# EasyEDA Pro project 数据采集模块 V2.4.eprj (continued)
## Nets
3V3: C15.2 C16.2 C39.2 C56.2 C63.2 C70.2 C77.2 C84.2 C91.2 C98.2 H4.1 H4.2 R1.1 R2.1 R3.1 TP2.1 U5.4(VOUT) U21.8(DVDD) U24.8(DVDD) U26.8(DVDD) U28.8(DVDD) U30.8(DVDD) U32.8(DVDD) U34.8(DVDD) U36.8(DVDD)
5V: C1.2 C2.2 C3.2 C4.1 C9.2 C10.2 C27.1 C28.1 C42.1 D1.2 H3.8 R4.1 R36.1 R38.1 R50.1 R62.2 TP5.1 U1.58(VCC5) U1.59(VCC5) U1.60(VCC5) U2.3(VIN) U3.3(VIN) U3.8(EN–) U3.12(EN+) U5.3(VIN) U7.1 U7.2 U7.3 U7.4 U7.5 U7.6 U39.2(RE#) U39.3(SHDN#) U39.8(VCC) U40.2(RE#) U40.3(SHDN#) U40.8(VCC) U41.2(RE#) U41.3(SHDN#) U41.8(VCC)
+A3V3: C11.2 C12.1 C50.2 C57.2 C64.2 C71.2 C78.2 C85.2 C92.2 C99.2 R21.2 TP3.1 U3.11(OUT+) U6.1(VDD) U23.14(VDD) U25.14(VDD) U27.14(VDD) U29.14(VDD) U31.14(VDD) U33.14(VDD) U35.14(VDD) U37.14(VDD)
-A3V3: C6.2 C18.2 C51.2 C58.2 C65.2 C72.2 C79.2 C86.2 C93.2 C100.2 R27.2 TP4.1 U3.6(OUT–) U6.27(VSS) U23.3(VSS) U25.3(VSS) U27.3(VSS) U29.3(VSS) U31.3(VSS) U33.3(VSS) U35.3(VSS) U37.3(VSS)
A3V3: C7.2 C8.2 C13.2 C37.2 C55.2 C62.2 C69.2 C76.2 C83.2 C90.2 C97.2 TP1.1 U2.4(VOUT) U4.6(VS+) U21.5(AVDD) U24.5(AVDD) U26.5(AVDD) U28.5(AVDD) U30.5(AVDD) U32.5(AVDD) U34.5(AVDD) U36.5(AVDD)
AGND: C1.1 C3.1 C4.2 C5.1 C6.1 C7.1 C8.1 C11.1 C12.2 C13.1 C18.1 C37.1 C43.1 C48.2 C50.1 C51.1 C52.1 C54.2 C55.1 C57.1 C58.1 C59.1 C61.2 C62.1 C64.1 C65.1 C66.1 C68.2 C69.1 C71.1 C72.1 C73.1 C75.2 C76.1 C78.1 C79.1 C80.1 C82.2 C83.1 C85.1 C86.1 C87.1 C89.2 C90.1 C92.1 C93.1 C94.1 C96.2 C97.1 C99.1 C100.1 H1.1 H1.3 H1.5 H1.7 H1.9 H1.11 H1.13 H1.15 H1.17 H1.19 H1.21 H1.23 H1.25 H1.27 H1.29 H1.31 H2.1 R22.1 R24.2 R26.1 R28.1 TP6.1 TP7.1 TP8.1 U2.1(GND) U3.4(GND) U3.13(EP) U4.7(GND) U6.12(GND) U21.1(AGND) U23.15(GND) U24.1(AGND) U25.15(GND) U26.1(AGND) U27.15(GND) U28.1(AGND) U29.15(GND) U30.1(AGND) U31.15(GND) U32.1(AGND) U33.15(GND) U34.1(AGND) U35.15(GND) U36.1(AGND) U37.15(GND)
GND: C2.1 C9.1 C10.1 C15.1 C16.1 C27.2 C28.2 C39.1 C42.2 C56.1 C63.1 C70.1 C77.1 C84.1 C91.1 C98.1 CN1.2 CN2.2 CN3.2 CN4.2 D1.1 H3.6 H4.5 H4.6 H5.1 LED1.1(C) R26.2 R35.2 R37.2 R49.2 TP9.1 U1.1(GND) U1.30(GND) U1.91(GND) U4.1(A1) U4.2(A0) U5.1(GND) U7.7 U7.8 U7.9 U7.10 U7.11 U7.12 U21.14(DGND) U24.14(DGND) U26.14(DGND) U28.14(DGND) U30.14(DGND) U32.14(DGND) U34.14(DGND) U36.14(DGND) U39.5(GND) U40.5(GND) U41.5(GND)
ADG16_A0: U1.94(PI0) U6.17(A0)
ADG16_A1: U1.93(PI1) U6.16(A1)
ADG16_A2: U1.92(PI2) U6.15(A2)
ADG16_A3: U1.101(PI3) U6.14(A3)
ADG16_EN: U1.95(PG11) U6.18(EN)
ADG_A0: U1.96(PI4) U23.1(A0) U25.1(A0) U27.1(A0) U29.1(A0) U31.1(A0) U33.1(A0) U35.1(A0) U37.1(A0)
ADG_A1: U1.97(PI5) U23.16(A1) U25.16(A1) U27.16(A1) U29.16(A1) U31.16(A1) U33.16(A1) U35.16(A1) U37.16(A1)
ADG_EN: U1.98(PI6) U23.2(EN) U25.2(EN) U27.2(EN) U29.2(EN) U31.2(EN) U33.2(EN) U35.2(EN) U37.2(EN)
AP1: CN1.3 R33.2 R36.2 U39.6(A)
AP2: CN3.3 R42.2 R50.2 U41.6(A)
AP3: CN2.3 R34.2 R38.2 U40.6(A)
BN1: CN1.1 R33.1 R35.1 U39.7(B)
BN2: CN3.1 R42.1 R49.1 U41.7(B)
BN3: CN2.1 R34.1 R37.1 U40.7(B)
BOOT0: R25.1 U1.31(BOOT0)
BOOT1: R30.2 U1.55(PB2)
I2C1_SCL: R3.2 U1.24(PB6) U4.5(SCL)
I2C1_SDA: R2.2 U1.25(PB7) U4.4(SDA)
INA226_ALERT: R1.2 U4.3(Alert)
IP_1: H1.2 U6.19(S1)
IP_2: H1.4 U6.20(S2)
IP_3: H1.6 U6.21(S3)
IP_4: H1.8 U6.22(S4)
IP_5: H1.10 U6.23(S5)
IP_6: H1.12 U6.24(S6)
IP_7: H1.14 U6.25(S7)
IP_8: H1.16 U6.26(S8)
IP_9: H1.18 U6.11(S9)
IP_10: H1.20 U6.10(S10)
IP_11: H1.22 U6.9(S11)
IP_12: H1.24 U6.8(S12)
IP_13: H1.26 U6.7(S13)
IP_14: H1.28 U6.6(S14)
IP_15: H1.30 U6.5(S15)
IP_16: H1.32 U6.4(S16)
IP_X: R23.2 U6.28(D)
KN0_1: U23.13(S1B) U38.1
KN0_2: U23.12(S2B) U38.3
KN0_3: U23.11(S3B) U38.5
KN0_4: U23.10(S4B) U38.7
KN0_5: U25.13(S1B) U38.9
KN0_6: U25.12(S2B) U38.11
KN0_7: U25.11(S3B) U38.13
KN0_8: U25.10(S4B) U38.15
KN0_9: U31.13(S1B) U38.17
KN0_10: U31.12(S2B) U38.19
KN0_11: U31.11(S3B) U38.21
KN0_12: U31.10(S4B) U38.23
KN0_13: U33.13(S1B) U38.25
KN0_14: U33.12(S2B) U38.27
KN0_15: U33.11(S3B) U38.29
KN0_16: U33.10(S4B) U38.31
KN0_X: R43.1 R44.1 U23.9(DB)
KN1_1: U27.13(S1B) U38.33
KN1_2: U27.12(S2B) U38.35
KN1_3: U27.11(S3B) U38.37
KN1_4: U27.10(S4B) U38.39
KN1_5: U29.13(S1B) U38.41
KN1_6: U29.12(S2B) U38.43
KN1_7: U29.11(S3B) U38.45
KN1_8: U29.10(S4B) U38.47
KN1_9: U35.13(S1B) U38.49
KN1_10: U35.12(S2B) U38.51
KN1_11: U35.11(S3B) U38.53
KN1_12: U35.10(S4B) U38.55
KN1_13: U37.13(S1B) U38.57
KN1_14: U37.12(S2B) U38.59
KN1_15: U37.11(S3B) U38.61
KN1_16: U37.10(S4B) U38.63
KN1_X: R63.1 R64.1 U25.9(DB)
KN2_X: R72.1 R73.1 U31.9(DB)
KN3_X: R75.1 R76.1 U33.9(DB)
KN4_X: R66.1 R67.1 U27.9(DB)
KN5_X: R69.1 R70.1 U29.9(DB)
KN6_X: R78.1 R79.1 U35.9(DB)
KN7_X: R81.1 R82.1 U37.9(DB)
KP0_1: U23.4(S1A) U38.2
KP0_2: U23.5(S2A) U38.4
KP0_3: U23.6(S3A) U38.6
KP0_4: U23.7(S4A) U38.8
KP0_5: U25.4(S1A) U38.10
KP0_6: U25.5(S2A) U38.12
KP0_7: U25.6(S3A) U38.14
KP0_8: U25.7(S4A) U38.16
KP0_9: U31.4(S1A) U38.18
KP0_10: U31.5(S2A) U38.20
KP0_11: U31.6(S3A) U38.22
KP0_12: U31.7(S4A) U38.24
KP0_13: U33.4(S1A) U38.26
KP0_14: U33.5(S2A) U38.28
KP0_15: U33.6(S3A) U38.30
KP0_16: U33.7(S4A) U38.32
KP0_X: R45.1 U23.8(DA)
KP1_1: U27.4(S1A) U38.34
KP1_2: U27.5(S2A) U38.36
KP1_3: U27.6(S3A) U38.38
KP1_4: U27.7(S4A) U38.40
KP1_5: U29.4(S1A) U38.42
KP1_6: U29.5(S2A) U38.44
KP1_7: U29.6(S3A) U38.46
KP1_8: U29.7(S4A) U38.48
KP1_9: U35.4(S1A) U38.50
KP1_10: U35.5(S2A) U38.52
KP1_11: U35.6(S3A) U38.54
KP1_12: U35.7(S4A) U38.56
KP1_13: U37.4(S1A) U38.58
KP1_14: U37.5(S2A) U38.60
KP1_15: U37.6(S3A) U38.62
KP1_16: U37.7(S4A) U38.64
KP1_X: R65.1 U25.8(DA)
KP2_X: R74.1 U31.8(DA)
KP3_X: R77.1 U33.8(DA)
KP4_X: R68.1 U27.8(DA)
KP5_X: R71.1 U29.8(DA)
KP6_X: R80.1 U35.8(DA)
KP7_X: R83.1 U37.8(DA)
LM_FB+: R21.1 R22.2 U3.2(FB+)
LM_FB-: R27.1 R28.2 U3.7(FB–)
MAX31856_CS_0: U1.23(PB5) U21.9(CS#)
MAX31856_CS_1: U1.19(PE3) U24.9(CS#)
MAX31856_CS_2: U1.16(PE6) U30.9(CS#)
MAX31856_CS_3: U1.6(PH3) U32.9(CS#)
MAX31856_CS_4: U1.11(PF9) U26.9(CS#)
MAX31856_CS_5: U1.70(PH9) U28.9(CS#)
MAX31856_CS_6: U1.67(PB15) U34.9(CS#)
MAX31856_CS_7: U1.64(PB12) U36.9(CS#)
MAX31856_DRDY_0: U1.21(PB3) U21.7(DRDY#)
MAX31856_DRDY_1: U1.20(PE2) U24.7(DRDY#)
MAX31856_DRDY_2: U1.17(PE5) U30.7(DRDY#)
MAX31856_DRDY_3: U1.13(PF7) U32.7(DRDY#)
MAX31856_DRDY_4: U1.12(PF8) U26.7(DRDY#)
MAX31856_DRDY_5: U1.71(PH10) U28.7(DRDY#)
MAX31856_DRDY_6: U1.68(PH6) U34.7(DRDY#)
MAX31856_DRDY_7: U1.65(PB13) U36.7(DRDY#)
MAX31856_FAULT_0: U1.22(PB4) U21.13(FAULT#)
MAX31856_FAULT_1: U1.18(PE4) U24.13(FAULT#)
MAX31856_FAULT_2: U1.15(PI11) U30.13(FAULT#)
MAX31856_FAULT_3: U1.5(PH2) U32.13(FAULT#)
MAX31856_FAULT_4: U1.9(PC1) U26.13(FAULT#)
MAX31856_FAULT_5: U1.69(PH7) U28.13(FAULT#)
MAX31856_FAULT_6: U1.66(PB14) U34.13(FAULT#)
MAX31856_FAULT_7: U1.63(PH8) U36.13(FAULT#)
MAX31856_SCK: U1.46(PA5) U21.10(SCK) U24.10(SCK) U26.10(SCK) U28.10(SCK) U30.10(SCK) U32.10(SCK) U34.10(SCK) U36.10(SCK)
MAX31856_SDI: U1.48(PA7) U21.12(SDI) U24.12(SDI) U26.12(SDI) U28.12(SDI) U30.12(SDI) U32.12(SDI) U34.12(SDI) U36.12(SDI)
MAX31856_SDO: U1.47(PA6) U21.11(SDO) U24.11(SDO) U26.11(SDO) U28.11(SDO) U30.11(SDO) U32.11(SDO) U34.11(SDO) U36.11(SDO)
REST: R29.2 U1.10(REST)
RS485_1_RX: U1.62(PB10) U39.4(DI)
RS485_1_TX: U1.61(PB11) U39.1(RO)
RS485_2_RX: U1.38(PC12) U41.4(DI)
RS485_2_TX: U1.37(PD2) U41.1(RO)
RS485_3_RX: U1.76(PC6) U40.4(DI)
RS485_3_TX: U1.77(PC7) U40.1(RO)
SWCLK: H3.2 U1.42(PA14)
SWDIO: H3.4 U1.43(PA13)
T0+: C43.2 C46.1 R45.2 U21.4(T+)
T0-: C46.2 C48.1 R44.2 U21.3(T-)
T1+: C52.2 C53.1 R65.2 U24.4(T+)
T1-: C53.2 C54.1 R63.2 U24.3(T-)
T2+: C73.2 C74.1 R74.2 U30.4(T+)
T2-: C74.2 C75.1 R72.2 U30.3(T-)
T3+: C80.2 C81.1 R77.2 U32.4(T+)
T3-: C81.2 C82.1 R75.2 U32.3(T-)
T4+: C59.2 C60.1 R68.2 U26.4(T+)
T4-: C60.2 C61.1 R66.2 U26.3(T-)
T5+: C66.2 C67.1 R71.2 U28.4(T+)
T5-: C67.2 C68.1 R69.2 U28.3(T-)
T6+: C87.2 C88.1 R80.2 U34.4(T+)
T6-: C88.2 C89.1 R78.2 U34.3(T-)
T7+: C94.2 C95.1 R83.2 U36.4(T+)
T7-: C95.2 C96.1 R81.2 U36.3(T-)
TTL_0_RX: CN4.1 U1.104(PE1)
TTL_0_TX: CN4.3 U1.103(PE0)
USART1_RX: H3.1 U1.52(PA10)
USART1_TX: H3.3 U1.51(PA9)
$1N15083: C17.2 R23.1 U4.10(VIN+)
$1N15089: C17.1 R24.1 U4.9(VIN-)
$1N29134: R43.2 U21.2(BIAS)
$1N35942: C14.2 U3.10(C1+)
$1N35947: C14.1 U3.9(C1–)
$1N36002: R4.2 U3.1(PGOOD)
$1N36045: C5.2 U3.5(CP)
$1N46830: H4.3 R25.2
$1N46836: H4.4 R30.1
$1N81567: H3.5 R29.1
$1N87410: LED1.2(A) R62.1
$1N116519: R64.2 U24.2(BIAS)
$1N118259: R67.2 U26.2(BIAS)
$1N118329: R70.2 U28.2(BIAS)
$1N121739: R73.2 U30.2(BIAS)
$1N121809: R76.2 U32.2(BIAS)
$1N121879: R79.2 U34.2(BIAS)
$1N121949: R82.2 U36.2(BIAS)

Not connected (* = marked no-connect by the designer): H3 7*; U1 2(VREF+) 3(PA1) 4(PA2) 7(PH5) 8(PH4) 14(PF6) 26(PB8) 27(PB9) 28(PC13) 29(VBAT) 32(PG14) 33(PG13) 34(PG10) 35(PD7) 36(PD3) 39(PC11) 40(PC10) 41(PA15) 44(PA3) 45(PA4) 49(PC4) 50(PC5) 53(PA11) 54(PA12) 56(PB0) 57(PB1) 72(PH11) 73(PG3) 74(PD13) 75(PG6) 78(PC8) 79(PC9) 80(PA8) 81(PD12) 82(PD5) 83(PD11) 84(PH12) 85(PG12) 86(PD4) 87(PD6) 88(PH15) 89(PH14) 90(PH13) 99(PI7) 100(PI8) 102(PA0) 105(PD14) 106(PD15) 107(PD0) 108(PD1) 109(PE7) 110(PE8) 111(PE9) 112(PE10) 113(PE11) 114(PE12) 115(PE13) 116(PE14) 117(PE15) 118(PD8) 119(PD9) 120(PD10); U2 2(VOUT)*; U4 8(VBUS)*; U5 2(VOUT)*; U6 2(NC)* 3(NC)* 13(NC)*; U21 6(DNC)*; U24 6(DNC)*; U26 6(DNC)*; U28 6(DNC)*; U30 6(DNC)*; U32 6(DNC)*; U34 6(DNC)*; U36 6(DNC)*

## Notes on the sheets
sheet 1
- STM32
- INA226
- ps.连接树莓派串口
- 485
- POWER
sheet 2
- MAX31856

# Schematic Schematic2
Board Name: Board2; Create Date: 2024-10-21; Page Name: 底板; Project Name: 数据采集模块 V2.4; Schematic Name: Schematic2; Update Date: 2025-04-19; Company: 嘉立创EDA; Page Size: A4; Version: V1.0
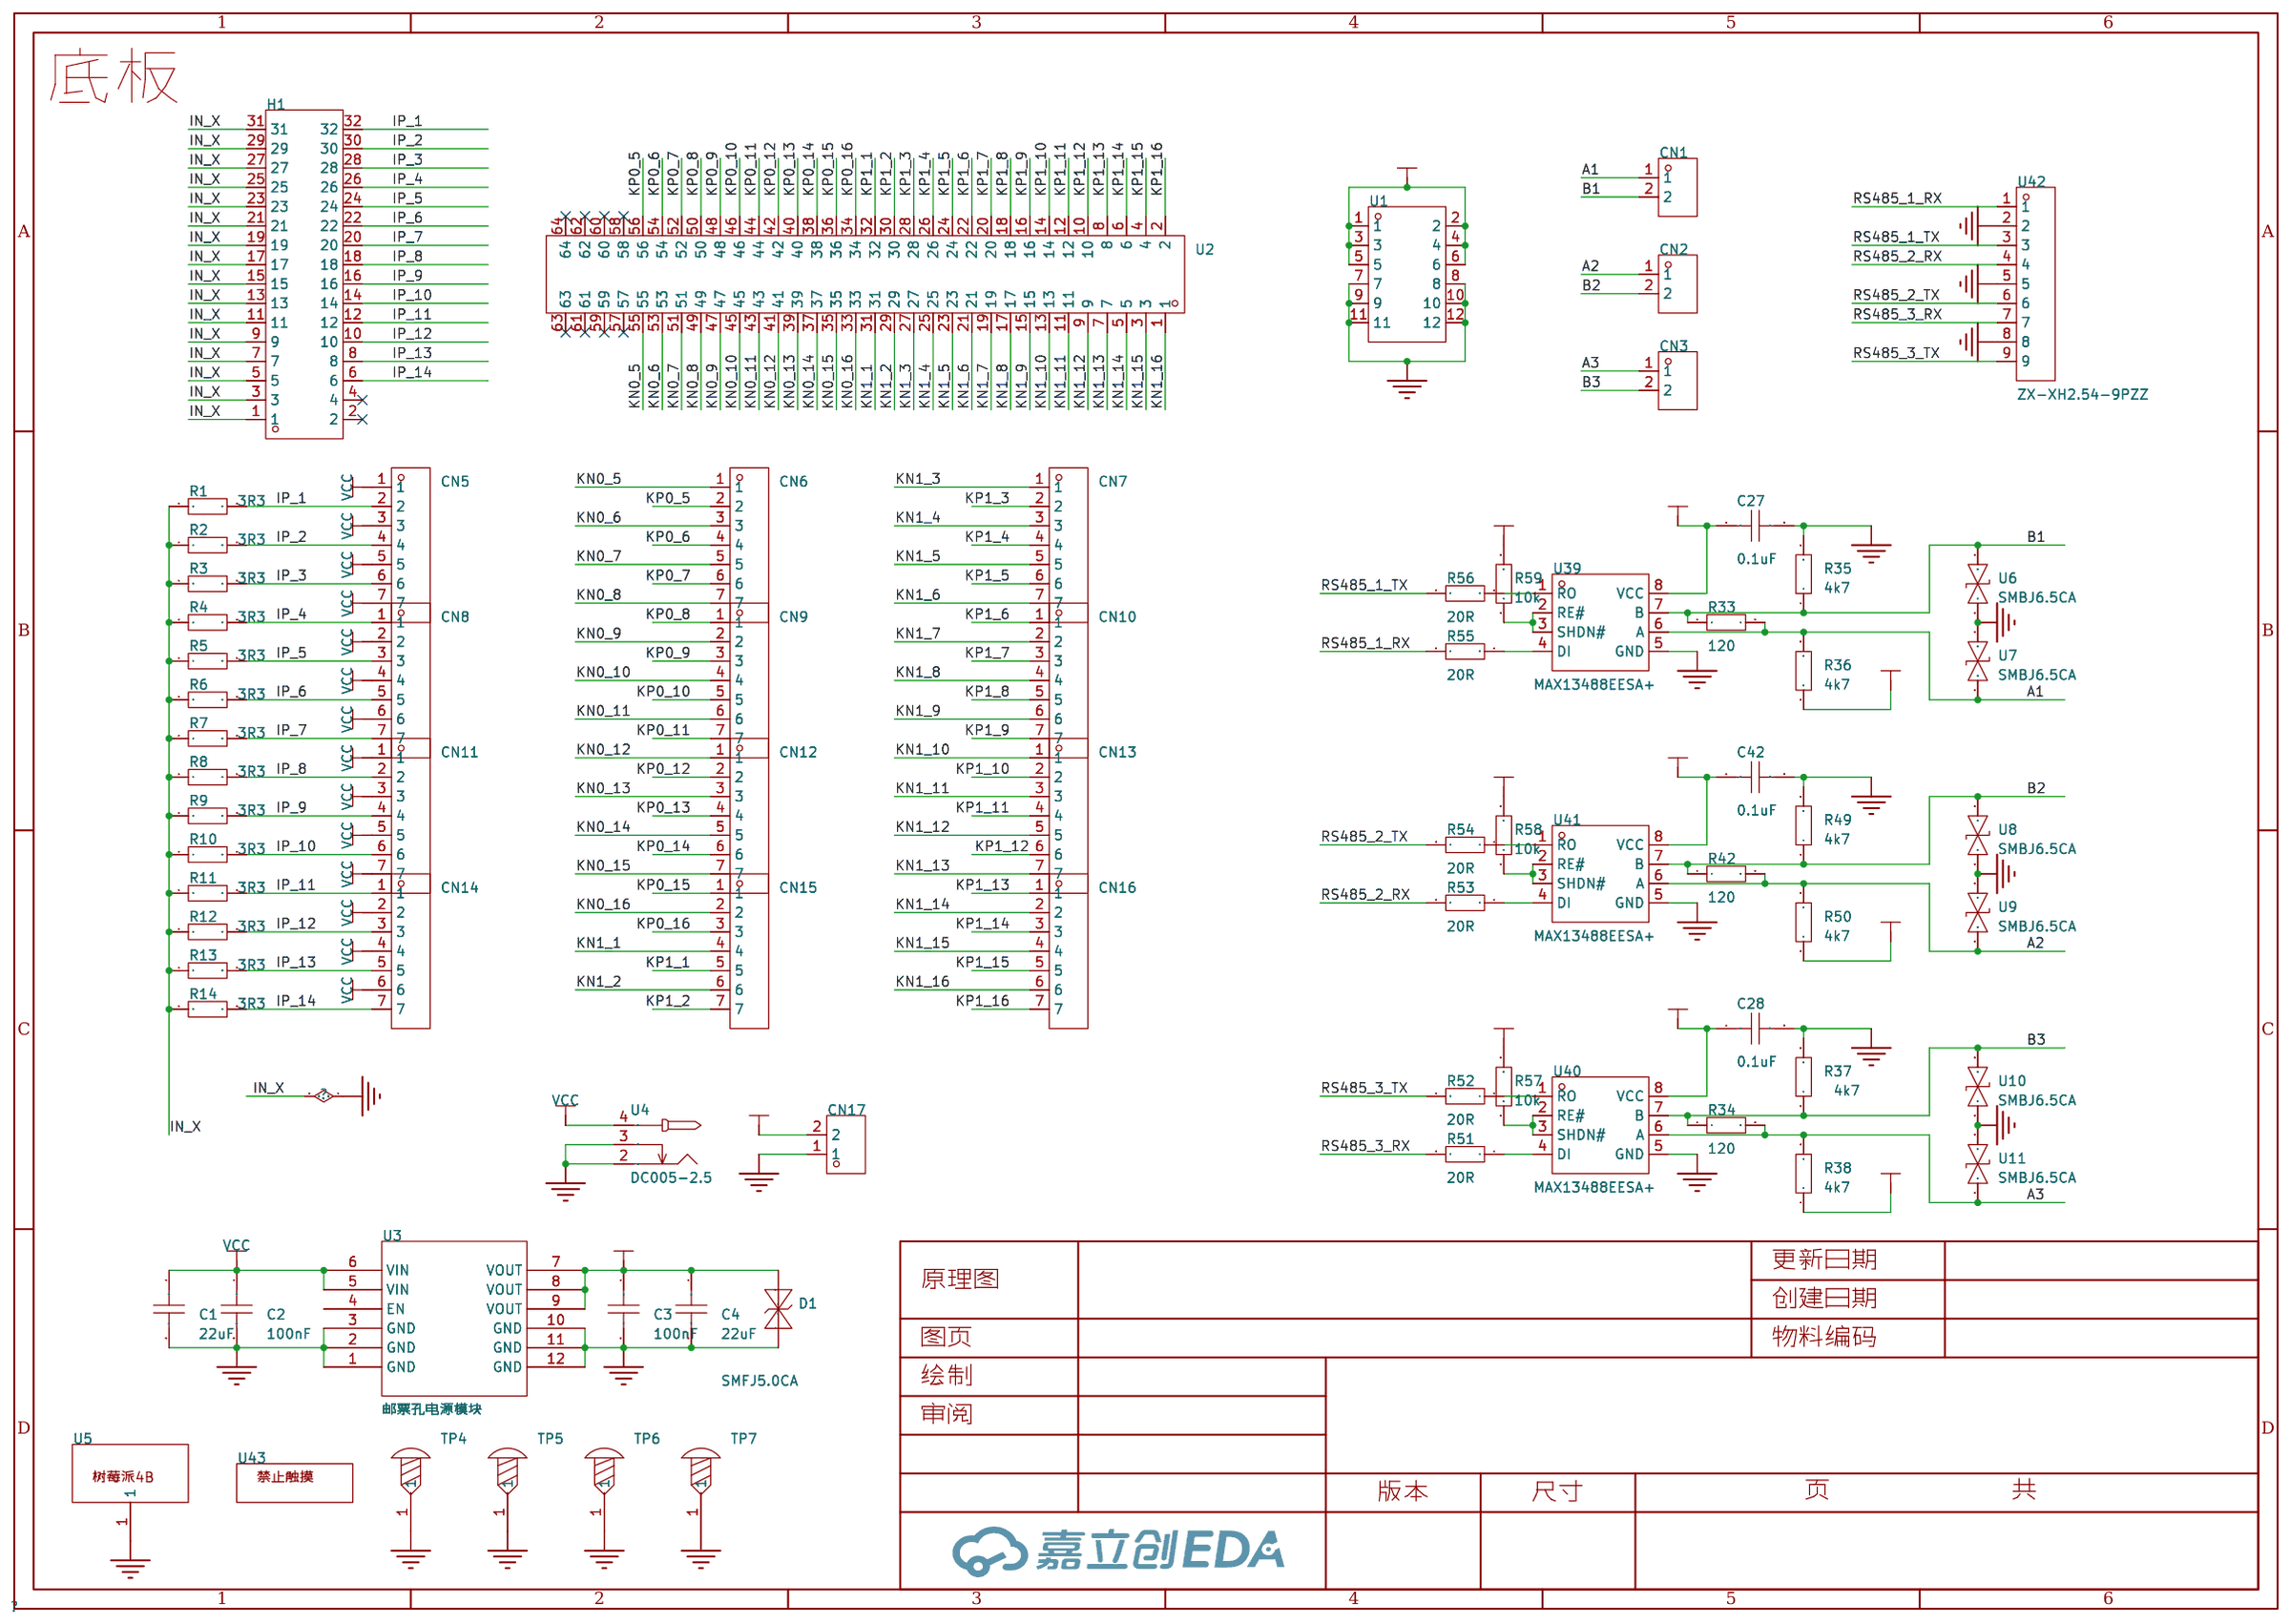
[diagram p2: schematic sheet]

## Parts
C1  22uF  [C0805]
C2  100nF  [C0603]
C3  100nF  [C0603]
C4  22uF  [C0805]
C27  0.1uF  [C0603]
C28  0.1uF  [C0603]
C42  0.1uF  [C0603]
CN1  KF2EDGR-5.08-2P  [CONN-TH_2P-P5.08_KF2EDGR-5.08-2P]
CN2  KF2EDGR-5.08-2P  [CONN-TH_2P-P5.08_KF2EDGR-5.08-2P]
CN3  KF2EDGR-5.08-2P  [CONN-TH_2P-P5.08_KF2EDGR-5.08-2P]
CN5  KF2EDGR-5.08-7P  [CONN-TH_7P-P5.08_KF2EDGR-5.08-7P]
CN6  KF2EDGR-5.08-7P  [CONN-TH_7P-P5.08_KF2EDGR-5.08-7P]
CN7  KF2EDGR-5.08-7P  [CONN-TH_7P-P5.08_KF2EDGR-5.08-7P]
CN8  KF2EDGR-5.08-7P  [CONN-TH_7P-P5.08_KF2EDGR-5.08-7P]
CN9  KF2EDGR-5.08-7P  [CONN-TH_7P-P5.08_KF2EDGR-5.08-7P]
CN10  KF2EDGR-5.08-7P  [CONN-TH_7P-P5.08_KF2EDGR-5.08-7P]
CN11  KF2EDGR-5.08-7P  [CONN-TH_7P-P5.08_KF2EDGR-5.08-7P]
CN12  KF2EDGR-5.08-7P  [CONN-TH_7P-P5.08_KF2EDGR-5.08-7P]
CN13  KF2EDGR-5.08-7P  [CONN-TH_7P-P5.08_KF2EDGR-5.08-7P]
CN14  KF2EDGR-5.08-7P  [CONN-TH_7P-P5.08_KF2EDGR-5.08-7P]
CN15  KF2EDGR-5.08-7P  [CONN-TH_7P-P5.08_KF2EDGR-5.08-7P]
CN16  KF2EDGR-5.08-7P  [CONN-TH_7P-P5.08_KF2EDGR-5.08-7P]
CN17  ZX-XH2.54-2PZZ  [CONN-TH_2P-P2.50_HX25003-2A]
D1  SMFJ5.0CA  [SOD-123_L2.7-W1.8-LS3.7-BI]
H1  X6521WV-2x16H-C60D30  [HDR-TH_32P-2.54-V-M-R2-C16-S2.54]
R1  3R3  [R1206]
R2  3R3  [R1206]
R3  3R3  [R1206]
R4  3R3  [R1206]
R5  3R3  [R1206]
R6  3R3  [R1206]
R7  3R3  [R1206]
R8  3R3  [R1206]
R9  3R3  [R1206]
R10  3R3  [R1206]
R11  3R3  [R1206]
R12  3R3  [R1206]
R13  3R3  [R1206]
R14  3R3  [R1206]
R33  120  [R0603]
R34  120  [R0603]
R35  4k7  [R0603]
R36  4k7  [R0603]
R37  4k7  [R0603]
R38  4k7  [R0603]
R42  120  [R0603]
R49  4k7  [R0603]
R50  4k7  [R0603]
R51  20R  [R0603]
R52  20R  [R0603]
R53  20R  [R0603]
R54  20R  [R0603]
R55  20R  [R0603]
R56  20R  [R0603]
R57  10k  [R0603]
R58  10k  [R0603]
R59  10k  [R0603]
TP4  -  [M3螺丝]
TP5  -  [M3螺丝]
TP6  -  [M3螺丝]
TP7  -  [M3螺丝]
U1  PZ254-2-06-Z-8.5KK  [HDR-TH_12P-P2.54-V-M-R2-C6-S2.54]
U2  X6521WV-2x32H-C60D30  [HDR-TH_64P-P2.54-V-M-R2-C32-S2.54-3]
U3  邮票孔电源模块  [邮票孔电源模块]
U4  DC005-2.5  [DC-IN-TH_DC005-2.5MM]
U5  -  [树莓派4B]
U6  SMBJ6.5CA  [SMB_L4.6-W3.5-LS5.3-BI]
U7  SMBJ6.5CA  [SMB_L4.6-W3.5-LS5.3-BI]
U8  SMBJ6.5CA  [SMB_L4.6-W3.5-LS5.3-BI]
U9  SMBJ6.5CA  [SMB_L4.6-W3.5-LS5.3-BI]
U10  SMBJ6.5CA  [SMB_L4.6-W3.5-LS5.3-BI]
U11  SMBJ6.5CA  [SMB_L4.6-W3.5-LS5.3-BI]
U39  MAX13488EESA+  [SO-8_L4.9-W3.9-P1.27-LS6.0-TL]
U40  MAX13488EESA+  [SO-8_L4.9-W3.9-P1.27-LS6.0-TL]
U41  MAX13488EESA+  [SO-8_L4.9-W3.9-P1.27-LS6.0-TL]
U42  ZX-XH2.54-9PZZ  [CONN-TH_9P-P2.50_ZX-XH2.54-9PZZ]
U43  -  [禁止触摸LOGO]

## Library data of the parts
C1 C4 = CAP_0805: Supplier Footprint: 0805
C2 C3 C27 C28 C42 = CAP_0603: Supplier Footprint: 0603
CN1-CN3 = KF2EDGR-5.08-2P: 连接器类型:板端/插座-开口;结构:1x2P;间距:5.08mm;颜色:绿色;安装方式:弯针;排数:1;每排PIN数:2;额定电流:15A;额定电压:300V;工作温度范围:-40℃~+105℃;; LCSC Part Name: 5.08mm 1x2P 排数:1 每排P数:2; Supplier Part: C441204; Manufacturer: KEFA(科发); Supplier Footprint: 弯插,P=5.08mm; JLCPCB Part Class: 扩展库; Datasheet: https://atta.szlcsc.com/upload/public/pdf/source/20230331/86255A6DF04E9E39F33DE3CFE8B3614A.pdf; Supplier: LCSC; Connector Type: 板端/插座-开口; Structure: 1x2P; Pitch: 5.08mm; Color: 绿色; Mounting Style: 弯针; Number of Pins: 2P; Number of Rows: 1; Number of PINs Per Row: 2; Current Rating (Max): 15A; Voltage Rating (Max): 300V; Operating Temperature Range: -40℃~+105℃
CN5-CN16 = KF2EDGR-5.08-7P: 连接器类型:板端/插座-开口;结构:1x7P;间距:5.08mm;颜色:绿色;安装方式:弯针;排数:1;每排PIN数:7;额定电流:15A;额定电压:300V;工作温度范围:-40℃~+105℃;; LCSC Part Name: 5.08mm 1x7P 排数:1 每排P数:7; Supplier Part: C441209; Manufacturer: KEFA(科发); Supplier Footprint: 弯插,P=5.08mm; JLCPCB Part Class: 扩展库; Datasheet: https://atta.szlcsc.com/upload/public/pdf/source/20230331/86255A6DF04E9E39F33DE3CFE8B3614A.pdf; Supplier: LCSC; Connector Type: 板端/插座-开口; Structure: 1x7P; Pitch: 5.08mm; Color: 绿色; Mounting Style: 弯针; Number of Pins: 7P; Number of Rows: 1; Number of PINs Per Row: 7; Current Rating (Max): 15A; Voltage Rating (Max): 300V; Operating Temperature Range: -40℃~+105℃
CN17 = ZX-XH2.54-2PZZ: 插针结构:1x2P;间距:2.54mm;安装方式:直插;参考系列:XH;总PIN数:2P;排数:1;每排PIN数:2;行距:-;额定电流:3A;触头材质:黄铜;触头镀层:锡;工作温度范围:-25℃~+85℃;; Supplier Part: C7429632; Manufacturer: Megastar(兆星); Supplier Footprint: 插件,P=2.54mm; JLCPCB Part Class: 扩展库; Datasheet: https://atta.szlcsc.com/upload/public/pdf/source/20230619/19BA6947230AA44A04D3EDD65E618FD0.pdf; Supplier: LCSC; Pins Structure: 1x2P; Pitch: 2.54mm; Mounting Style: 直插; Reference Series: XH; Number of Pins: 2P; Number of Rows: 1; Number of PINs Per Row: 2; Current Rating (Max): 3A; Contact Material: 黄铜; Contact Plating: 锡; Operating Temperature Range: -25℃~+85℃
D1 = SMFJ5.0CA: 反向截止电压(Vrwm):5V;最大钳位电压:9.2V;峰值脉冲电流(Ipp)@10/1000us:21.7A;击穿电压:6.4V;; Supplier Part: C2905638; Manufacturer: TECH PUBLIC(台舟); Supplier Footprint: SOD-123FL; JLCPCB Part Class: 扩展库; Datasheet: https://atta.szlcsc.com/upload/public/pdf/source/20211026/3B8FA2C5551EFBFD99ABC853C5618374.pdf; Supplier: LCSC; Reverse Stand-Off Voltage (Vrwm): 5V; Maximum Clamping Voltage: 9.2V; Peak Pulse Current (Ipp)@10/1000us: 21.7A; Breakdown Voltage: 6.4V; Reverse Leakage Current (Ir): 400uA; Type: TVS
H1 = X6521WV-2x16H-C60D30: 插针结构:2x16P;间距:2.54mm;行距:2.54mm;圆针/方针:方针;安装类型:-;排数:双排;总PIN位数:32P;额定电流:3A;额定电压:250V;配合针长度:-;塑高:2.5mm;端接针长度:-;触头材质:黄铜;触头镀层:金;工作温度范围:-40℃~+105℃;焊接温度(最大值):260℃;颜色:黑色;; LCSC Part Name: 2x16P 间距:2.54mm 方针; Supplier Part: C725888; Manufacturer: XKB Connection(中国星坤); Supplier Footprint: 插件,P=2.54mm; JLCPCB Part Class: 扩展库; Datasheet: https://atta.szlcsc.com/upload/public/pdf/source/20211009/DE33EBA4104B5B447A7BD8383FBBA145.pdf; Supplier: LCSC; Pin Structure: 2x16P; Pitch: 2.54mm; Row Spacing: 2.54mm; Circluar Pins/Square Pins: 方针; Number of Rows: 双排; Number of Pins: 32P; Current Rating (Max): 3A; Voltage Rating (Max): 250V; Insulation Height: 2.5mm; Contact Material: 黄铜; Contact Plating: 金; Operating Temperature Range: -40℃~+105℃; Soldering Temperature(Max): 260℃; Color: 黑色
R1-R14 = Res_1206: Supplier Footprint: 1206
R33-R38 R42 R49-R59 = Res_0603: Supplier Footprint: 0603
TP4-TP7 = M3螺丝: Supplier Footprint: 插件
U1 = PZ254-2-06-Z-8.5KK: LCSC Part Name: 2.54mm 被合并商品; Supplier Part: C3012246; Supplier Footprint: 插件,P=2.54mm; JLCPCB Part Class: 扩展库; Supplier: LCSC
U2 = X6521WV-2x32H-C60D30: 插针结构:2x32P;间距:2.54mm;行距:2.54mm;圆针/方针:方针;安装类型:-;排数:双排;总PIN位数:64P;额定电流:3A;额定电压:250V;配合针长度:-;塑高:2.5mm;端接针长度:-;触头材质:黄铜;触头镀层:金;工作温度范围:-40℃~+105℃;焊接温度(最大值):260℃;颜色:黑色;; LCSC Part Name: 2x32P 间距:2.54mm 方针; Supplier Part: C2883966; Manufacturer: XKB Connection(中国星坤); Supplier Footprint: 插件,P=2.54mm; JLCPCB Part Class: 扩展库; Datasheet: https://atta.szlcsc.com/upload/public/pdf/source/20230515/3562B41AC32B1731F21EFD73DC35CC6C.pdf; Supplier: LCSC; Pin Structure: 2x32P; Pitch: 2.54mm; Row Spacing: 2.54mm; Circluar Pins/Square Pins: 方针; Number of Rows: 双排; Number of Pins: 64P; Current Rating (Max): 3A; Voltage Rating (Max): 250V; Insulation Height: 2.5mm; Contact Material: 黄铜; Contact Plating: 金; Operating Temperature Range: -40℃~+105℃; Soldering Temperature(Max): 260℃; Color: 黑色
U3 = 邮票孔电源模块: kvdz.taobao.com; Library Name: 邮票孔电源模块ylt
U4 = DC005-2.5: 连接器类型:DC电源插座;安装方式:弯插;触点内径:2.5mm;触点外径:6.3mm;额定电流:500mA;额定电压:12V;工作温度范围:-25℃~+85℃;; LCSC Part Name: DC电源插座 内径:2.5mm 外径:6.3mm; Supplier Part: C7507454; Manufacturer: SHOU HAN(首韩); Supplier Footprint: 插件; JLCPCB Part Class: 扩展库; Datasheet: https://atta.szlcsc.com/upload/public/pdf/source/20231013/7634FFE9E6B635EE77C0C008CDC877DB.pdf; Supplier: LCSC; Connector Type: DC电源插座; Mounting Style: 弯插; Inside Contact Diameter: 2.5mm; Outside Contact Diameter: 6.3mm; Current Rating (Max): 500mA; Voltage Rating (Max): 12V; Operating Temperature Range: -25℃~+85℃
U5 = 树莓派4B
U6-U11 = SMBJ6.5CA_C7420377: 极性:双向;反向截止电压(Vrwm):6.5V;最大钳位电压:11.2V;峰值脉冲电流(Ipp)@10/1000us:53.57A;峰值脉冲功率(Ppp)@10/1000us:600W;击穿电压:7.22V;; Supplier Part: C7420377; Manufacturer: 宏迦橙; Supplier Footprint: SMB; JLCPCB Part Class: 扩展库; Datasheet: https://atta.szlcsc.com/upload/public/pdf/source/20240521/1CEEED45C5E1E6D6901B31DABD34A136.pdf; Supplier: LCSC; polarity: 双向; Reverse Stand-Off Voltage (Vrwm): 6.5V; Maximum Clamping Voltage: 11.2V; Peak Pulse Current (Ipp)@10/1000us: 53.57A; Peak Pulse Power Dissipation (Ppp)@10/1000us: 600W; Breakdown Voltage: 7.22V; Reverse Leakage Current (Ir): 500uA; Number of Lines: 单路; Operating Temperature: -55℃~+155℃; Type: TVS
U39-U41 = MAX13488EESA+: 类型:收发器;数据速率:16Mbps;驱动器/接收器:1/1;; LCSC Part Name: MAX13488EESA; Supplier Part: C143343; Manufacturer: ADI(亚德诺)/MAXIM(美信); Supplier Footprint: SO-8; JLCPCB Part Class: 扩展库; Datasheet: https://atta.szlcsc.com/upload/public/pdf/source/20171202/C156258_15122106256341160224.pdf; Supplier: LCSC; Types: 收发器; Supply Voltage: 4.75V~5.25V; Data Rate: 16Mbps; Driver/receiver: 1/1; Operating Temperature: -40℃~+85℃
U42 = ZX-XH2.54-9PZZ: Supplier Part: C7429639; Manufacturer: Megastar(兆星); Supplier Footprint: 插件,P=2.54mm; JLCPCB Part Class: 扩展库; Datasheet: https://atta.szlcsc.com/upload/public/pdf/source/20230619/A41EC9057C60B306F9C507100E2CF652.pdf; Supplier: LCSC; Pins Structure: 1x9P; Pitch: 2.54mm; Mounting Style: 直插; Reference Series: XH; Number of Pins: 9P; Number of Rows: 1; Number of PINs Per Row: 9; Current Rating (Max): 3A; Contact Material: 黄铜; Contact Plating: 锡; Operating Temperature Range: -25℃~+85℃
U43 = 禁止触摸LOGO

## Nets
5V: C3.1 C4.1 C27.1 C28.1 C42.1 CN17.2 D1.2 R36.1 R38.1 R50.1 R57.2 R58.2 R59.2 U1.1 U1.2 U1.3 U1.4 U1.5 U1.6 U3.7(VOUT) U3.8(VOUT) U3.9(VOUT) U39.8(VCC) U40.8(VCC) U41.8(VCC)
GND: C1.2 C2.2 C3.2 C4.2 C27.2 C28.2 C42.2 CN17.1 D1.1 H1.1 H1.3 H1.5 H1.7 H1.9 H1.11 H1.13 H1.15 H1.17 H1.19 H1.21 H1.23 H1.25 H1.27 H1.29 H1.31 R1.1 R2.1 R3.1 R4.1 R5.1 R6.1 R7.1 R8.1 R9.1 R10.1 R11.1 R12.1 R13.1 R14.1 R35.2 R37.2 R49.2 TP4.1 TP5.1 TP6.1 TP7.1 U1.7 U1.8 U1.9 U1.10 U1.11 U1.12 U3.1(GND) U3.2(GND) U3.3(GND) U3.10(GND) U3.11(GND) U3.12(GND) U4.2 U4.3 U5.1 U6.1 U7.2 U8.1 U9.2 U10.1 U11.2 U39.5(GND) U40.5(GND) U41.5(GND) U42.2 U42.5 U42.8
VCC: C1.1 C2.1 CN5.1 CN5.3 CN5.5 CN5.7 CN8.2 CN8.4 CN8.6 CN11.1 CN11.3 CN11.5 CN11.7 CN14.2 CN14.4 CN14.6 U3.5(VIN) U3.6(VIN) U4.4
A1: CN1.1 R33.2 R36.2 U7.1 U39.6(A)
A2: CN2.1 R42.2 R50.2 U9.1 U41.6(A)
A3: CN3.1 R34.2 R38.2 U11.1 U40.6(A)
B1: CN1.2 R33.1 R35.1 U6.2 U39.7(B)
B2: CN2.2 R42.1 R49.1 U8.2 U41.7(B)
B3: CN3.2 R34.1 R37.1 U10.2 U40.7(B)
IP_1: CN5.2 H1.32 R1.2
IP_2: CN5.4 H1.30 R2.2
IP_3: CN5.6 H1.28 R3.2
IP_4: CN8.1 H1.26 R4.2
IP_5: CN8.3 H1.24 R5.2
IP_6: CN8.5 H1.22 R6.2
IP_7: CN8.7 H1.20 R7.2
IP_8: CN11.2 H1.18 R8.2
IP_9: CN11.4 H1.16 R9.2
IP_10: CN11.6 H1.14 R10.2
IP_11: CN14.1 H1.12 R11.2
IP_12: CN14.3 H1.10 R12.2
IP_13: CN14.5 H1.8 R13.2
IP_14: CN14.7 H1.6 R14.2
KN0_5: CN6.1 U2.55
KN0_6: CN6.3 U2.53
KN0_7: CN6.5 U2.51
KN0_8: CN6.7 U2.49
KN0_9: CN9.2 U2.47
KN0_10: CN9.4 U2.45
KN0_11: CN9.6 U2.43
KN0_12: CN12.1 U2.41
KN0_13: CN12.3 U2.39
KN0_14: CN12.5 U2.37
KN0_15: CN12.7 U2.35
KN0_16: CN15.2 U2.33
KN1_1: CN15.4 U2.31
KN1_2: CN15.6 U2.29
KN1_3: CN7.1 U2.27
KN1_4: CN7.3 U2.25
KN1_5: CN7.5 U2.23
KN1_6: CN7.7 U2.21
KN1_7: CN10.2 U2.19
KN1_8: CN10.4 U2.17
KN1_9: CN10.6 U2.15
KN1_10: CN13.1 U2.13
KN1_11: CN13.3 U2.11
KN1_12: CN13.5 U2.9
KN1_13: CN13.7 U2.7
KN1_14: CN16.2 U2.5
KN1_15: CN16.4 U2.3
KN1_16: CN16.6 U2.1
KP0_5: CN6.2 U2.56
KP0_6: CN6.4 U2.54
KP0_7: CN6.6 U2.52
KP0_8: CN9.1 U2.50
KP0_9: CN9.3 U2.48
KP0_10: CN9.5 U2.46
KP0_11: CN9.7 U2.44
KP0_12: CN12.2 U2.42
KP0_13: CN12.4 U2.40
KP0_14: CN12.6 U2.38
KP0_15: CN15.1 U2.36
KP0_16: CN15.3 U2.34
KP1_1: CN15.5 U2.32
KP1_2: CN15.7 U2.30
KP1_3: CN7.2 U2.28
KP1_4: CN7.4 U2.26
KP1_5: CN7.6 U2.24
KP1_6: CN10.1 U2.22
KP1_7: CN10.3 U2.20
KP1_8: CN10.5 U2.18
KP1_9: CN10.7 U2.16
KP1_10: CN13.2 U2.14
KP1_11: CN13.4 U2.12
KP1_12: CN13.6 U2.10
KP1_13: CN16.1 U2.8
KP1_14: CN16.3 U2.6
KP1_15: CN16.5 U2.4
KP1_16: CN16.7 U2.2
RS485_1_RX: R55.2 U42.1
RS485_1_TX: R56.2 U42.3
RS485_2_RX: R53.2 U42.4
RS485_2_TX: R54.2 U42.6
RS485_3_RX: R51.2 U42.7
RS485_3_TX: R52.2 U42.9
$1N43756: R58.1 U41.2(RE#) U41.3(SHDN#)
$1N43769: R57.1 U40.2(RE#) U40.3(SHDN#)
$1N43779: R59.1 U39.2(RE#) U39.3(SHDN#)
$1N44097: R51.1 U40.4(DI)
$1N44147: R52.1 U40.1(RO)
$1N44197: R53.1 U41.4(DI)
$1N44199: R54.1 U41.1(RO)
$1N44249: R55.1 U39.4(DI)
$1N44251: R56.1 U39.1(RO)

Not connected (* = marked no-connect by the designer): H1 2* 4*; U2 57* 58* 59* 60* 61* 62* 63* 64*; U3 4(EN)

## Notes on the sheet
- 底板
